# EasyEDA Pro project BCI_TESTING_BOARD.eprj, board BCI_Board
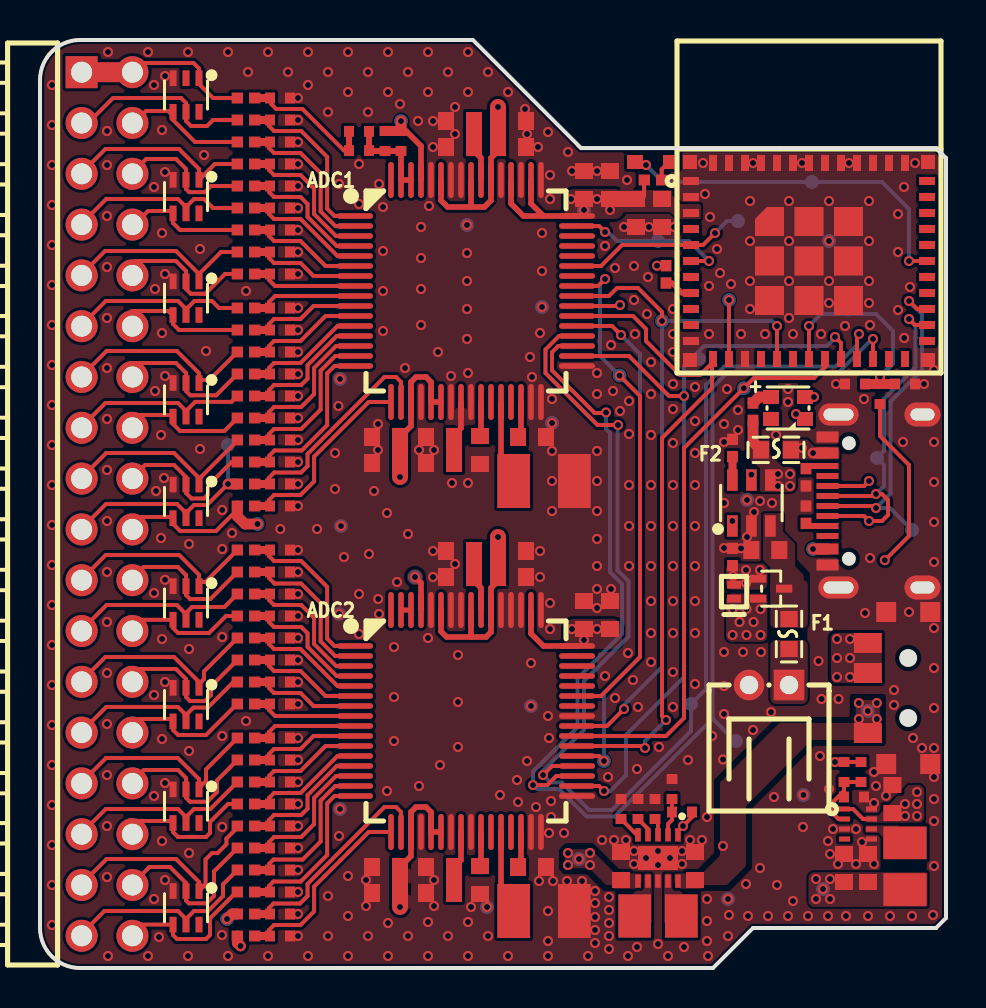
[diagram p4: board, top side]
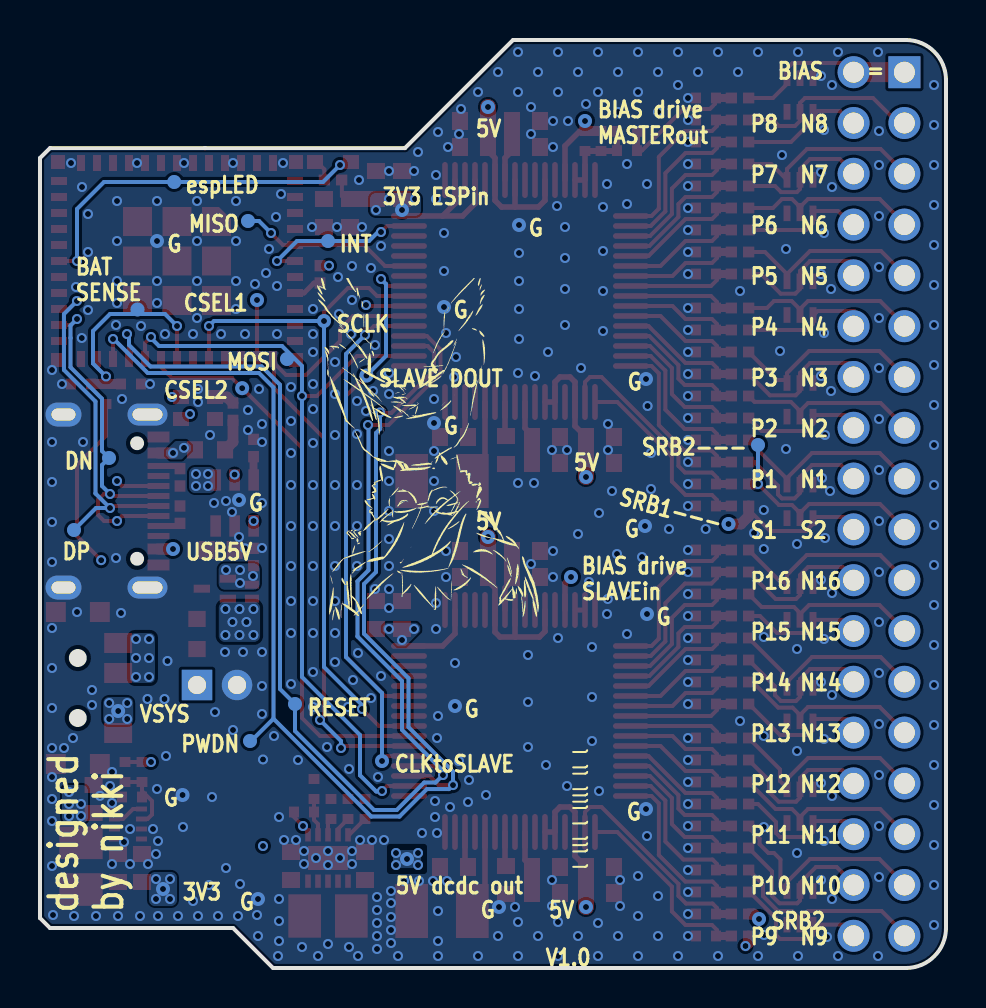
[diagram p5: board, bottom side, seen from below]

Outline 45.3 x 46.4 mm; copper layers: Top Layer, Inner1, Inner2, Bottom Layer. Coordinates in mm from the lower left corner of the outline.
Outline path: 0,44.4 0,2 arc(0.59,0.59) 2,0 33.65,0 35.65,2 44.8,2 45.3,2.5 45.3,2.5 45.3,40.49 45.3,40.49 44.8,40.99 27.05,40.99 21.64,46.4 2,46.4 arc(0.59,45.81) 0,44.4
Stack: Top Layer 0.035mm 外层铜厚1oz / Dielectric1 0.28mm 7628 RC49% 8.6mil / Inner1 0.035mm 内层铜厚 / Dielectric2 0.28mm 1.1mm H/HOZ 含铜 / Inner2 0.035mm 内层铜厚 / Dielectric3 0.28mm 7628 RC49% 8.6mil / Bottom Layer 0.035mm 外层铜厚1oz

## Design rules (mm)
template: 用户自定义配置
spacing Default (default): track to track 0.127, other pairs 0 to 0.127
track width Default (default): min 0.127, default 0.127, max 25.4
differential pair differentialPair (default): width min 0.127, default 0.254, max 2.54; gap min 0.152, default 0.152
via Default (default): diameter min 0.5, default 0.61, max 100.025; hole min 0.3, default 0.305, max 59.995
net GND uses gge20879(1)
net 5V uses gge20879(1)
pour e144 uses gge20879(1)
pour e4232 uses gge20879(1)
pour e3363 uses gge20879(1)
pour e3540 uses gge20879(1)
pour e1719 uses gge20879(1)
pour e1148 uses gge20879(1)
pour e7396 uses gge20879(1)
pour e17882 uses gge20879(1)
pour e4641 uses gge20879(1)
pour e8198 uses gge20879(1)
pour e9053 uses gge20879(1)
pour e2428 uses gge20879(1)
pour e1776 uses gge20879(1)
pour e16471 uses gge20879(1)
pour e20188 uses gge20879(1)
pour e28357 uses gge20879(1)
pour e986 uses gge20879(1)
pour e3342 uses gge20879(1)
pour e4173 uses gge20879(1)
pour e4651 uses gge20879(1)
pour e4938 uses gge20879(1)
pour e2614 uses gge20879(1)
pour e1422 uses gge20879(1)
pour e4659 uses gge20879(1)
pour e5927 uses gge20879(1)
pour e11420 uses gge20879(1)
pour e10603 uses gge20879(1)
pour e60502 uses gge20879(1)
pour e60981 uses gge20879(1)
pour e61780 uses gge20879(1)
pour e62245 uses gge20879(1)
pour e66682 uses gge20879(1)
pour e68252 uses gge20879(1)
pour e68438 uses gge20879(1)
pour e69166 uses gge20879(1)
pour e59833 uses gge20879(1)
pour e60166 uses gge20879(1)
pour e60163 uses gge20879(1)
pour e86477 uses gge20879(1)
pour e92652 uses gge20879(1)
pour e94208 uses gge20879(1)
pour e95223 uses gge20879(1)
pour e1714 uses gge20879(1)
pour e3613 uses gge20879(1)
pour e7332 uses gge20879(1)
pour e12201 uses gge20879(1)
pour e12398 uses gge20879(1)
pour e18760 uses gge20879(1)
pour e20440 uses gge20879(1)
pour e20447 uses gge20879(1)
pour e31094 uses gge20879(1)
pour e32431 uses gge20879(1)
pour e68747 uses gge20879(1)
pour e75484 uses gge20879(1)

## Placement (name value [footprint] x y rotation side)
ADC1  ADS1299IPAGR  [TQFP-64_L10.0-W10.0-P0.50-LS12.0-TL]  21.3 33.85 0 top
ADC2  ADS1299IPAGR  [TQFP-64_L10.0-W10.0-P0.50-LS12.0-TL]  21.3 12.35 0 top
C17  100nF  [C0603]  20 26.55 0 top
C18  10uF  [C0603]  20 25.25 0 top
C19  1uF  [C0603]  22 25.9 270 top
C20  1uF  [C0603]  24.6 26.55 180 top
C21  100uF  [C1210]  25.2 24.35 0 top
C22  1uF  [C0603]  21 42.35 180 top
C23  100nF  [C0603]  21 41.05 180 top
C24  1uF  [C0603]  17.3 25.25 0 top
C25  100nF  [C0603]  17.3 26.55 0 top
C26  10uF  [C0603]  23.6 42.35 180 top
C27  100nF  [C0603]  23.6 41.05 180 top
C28  100nF  [C0603]  27.2 39.15 270 top
C29  1uF  [C0603]  28.5 39.15 270 top
C30  1uF  [C0603]  24.6 5.05 180 top
C31  1uF  [C0603]  22 4.4 270 top
C32  100nF  [C0603]  20 5.05 0 top
C33  100uF  [C1210]  25.2 2.85 0 top
C34  1uF  [C0603]  21 20.85 180 top
C35  100nF  [C0603]  21 19.55 180 top
C36  100nF  [C0603]  17.3 5.05 0 top
C37  100nF  [C0603]  23.6 19.55 180 top
C38  10uF  [C0603]  20 3.75 0 top
C39  10uF  [C0603]  23.6 20.85 180 top
C40  1uF  [C0603]  17.3 3.75 0 top
C41  100nF  [C0603]  27.2 17.65 270 top
C42  1uF  [C0603]  28.5 17.65 270 top
C101  4.7nF  [C0402 small]  12 25.3 0 top
C102  4.7nF  [C0402 small]  12 26.4 180 top
C103  4.7nF  [C0402 small]  12 27.5 0 top
C104  4.7nF  [C0402 small]  12 28.6 180 top
C105  4.7nF  [C0402 small]  12 29.7 0 top
C106  4.7nF  [C0402 small]  12 30.8 180 top
C107  4.7nF  [C0402 small]  12 31.9 0 top
C108  4.7nF  [C0402 small]  12 33 180 top
C109  4.7nF  [C0402 small]  12 34.7 0 top
C110  4.7nF  [C0402 small]  12 35.8 180 top
C111  4.7nF  [C0402 small]  12 36.9 0 top
C112  4.7nF  [C0402 small]  12 38 180 top
C113  4.7nF  [C0402 small]  12 39.1 0 top
C114  4.7nF  [C0402 small]  12 40.2 180 top
C115  4.7nF  [C0402 small]  12 41.3 0 top
C116  4.7nF  [C0402 small]  12 42.4 180 top
C201  4.7nF  [C0402 small]  12 3.8 0 top
C202  4.7nF  [C0402 small]  12 4.9 180 top
C203  4.7nF  [C0402 small]  12 6 0 top
C204  4.7nF  [C0402 small]  12 7.1 180 top
C205  4.7nF  [C0402 small]  12 8.2 0 top
C206  4.7nF  [C0402 small]  12 9.3 180 top
C207  4.7nF  [C0402 small]  12 10.4 0 top
C208  4.7nF  [C0402 small]  12 11.5 180 top
C209  4.7nF  [C0402 small]  12 13.2 0 top
C210  4.7nF  [C0402 small]  12 14.3 180 top
C211  4.7nF  [C0402 small]  12 15.4 0 top
C212  4.7nF  [C0402 small]  12 16.5 180 top
C213  4.7nF  [C0402 small]  12 17.6 0 top
C214  4.7nF  [C0402 small]  12 18.7 180 top
C215  4.7nF  [C0402 small]  12 19.8 0 top
C216  4.7nF  [C0402 small]  12 20.9 180 top
C222  10uF  [C0603]  29.8 37.75 270 top
C223  100nF  [C0603]  31.1 37.75 270 top
C227  4.7uF  [C0603]  42.62 8.45 270 top
C228  10uF  [C0603]  41.4 5 270 top
C231  10uF  [C0603]  40.2 5 90 top
C232  10uF  [C0603]  32.75 5.1 90 top
C233  22uF  [C0603]  29.05 5.1 270 top
C234  120pF  [C0402 small]  41.05 9.8 90 top
C_adc  100nF  [C0402 small]  40.75 29.2 180 top
CBIAS1  4.7nF  [C0402 small]  12 43.5 180 top
Cbias3  1.5nF  [C0402 small]  15.95 41.83 0 top
Cbias4  1.5nF  [C0402 small]  17.25 41.35 90 top
CP1  10uF  [C0603]  36.27 20.9 0 top
Csrb11  4.7nF  [C0402 small]  12 23.1 180 top
Csrb12  4.7nF  [C0402 small]  12 24.2 0 top
Csrb21  4.7nF  [C0402 small]  12 1.6 180 top
Csrb22  4.7nF  [C0402 small]  12 2.7 0 top
D1  TPD4E1B06DCKR  [SC-70-6_L2.2-W1.3-P0.65-LS2.1-BL]  7.3 23.33 180 top
D2  TPD4E1B06DCKR  [SC-70-6_L2.2-W1.3-P0.65-LS2.1-BL]  7.3 28.41 180 top
D3  TPD4E1B06DCKR  [SC-70-6_L2.2-W1.3-P0.65-LS2.1-BL]  7.3 33.49 180 top
D4  TPD4E1B06DCKR  [SC-70-6_L2.2-W1.3-P0.65-LS2.1-BL]  7.3 38.57 180 top
D5  TPD4E1B06DCKR  [SC-70-6_L2.2-W1.3-P0.65-LS2.1-BL]  7.3 43.65 180 top
D7  TPD4E1B06DCKR  [SC-70-6_L2.2-W1.3-P0.65-LS2.1-BL]  7.3 3.01 180 top
D8  TPD4E1B06DCKR  [SC-70-6_L2.2-W1.3-P0.65-LS2.1-BL]  7.3 8.09 180 top
D9  TPD4E1B06DCKR  [SC-70-6_L2.2-W1.3-P0.65-LS2.1-BL]  7.3 13.17 180 top
D10  TPD4E1B06DCKR  [SC-70-6_L2.2-W1.3-P0.65-LS2.1-BL]  7.3 18.25 180 top
D11  RB161QS-40T18R  [X2-DFN1006-2_L1.0-W0.6-P0.65-RD]  34.7 18.82 90 top
F1  0467001.NRHF  [F0603]  37.45 16.7 270 top
F2  0467001.NRHF  [F0603]  36.8 25.91 180 top
H3  X6521WR-2x18H-C60D30  [HDR-TH_36P-P2.54-H-M-R2-C18-S2.54]  3.35 23.2 270 top
L1  470nH  [L1008]  43.25 5.09 270 top
L2  2.2uH  [L1008]  30.9 2.6 180 top
LED1  NH-B2020RGBA-HF  [LED-ARRAY-SMD_4P-L2.1-W2.1-TL_NH-B2020RGBA]  37.4 28 180 top
LED2  XL-1606UWC  [LED-SMD_L1.7-W0.6-RD]  30.65 40.3 0 top
NOREF  -  [Pad_e34786]  9.4 26.15 0 top
NOREF#2  -  [Pad_e23853]  34.45 33.4 0 top
NOREF#3  -  [Pad_e26715]  38.65 20.95 0 top
NOREF#4  -  [Pad_e45393]  34.4 3.45 0 top
NOREF#5  -  [Pad_e34781]  18.75 19.55 0 top
NOREF#6  -  [Pad_e10843]  9.35 2.45 0 top
NOREF#7  -  [Pad_e34780]  18 3.05 0 top
NOREF#8  -  [Pad_e15223]  15 7.95 0 top
NOREF#9  -  [Pad_e43292]  35.35 23.4 0 top
NOREF#10  -  [Pad_e33291]  34.9 37.35 270 top
NOREF#11  -  [Pad_e34785]  22.9 21.55 0 top
NOREF#12  -  [Pad_e34784]  22.9 43.05 0 top
NOREF#13  -  [Pad_e22556]  22.35 3.05 0 top
NOREF#14  -  [Pad_e26879]  30.9 36.35 0 top
NOREF#15  -  [Pad_e26221]  26.95 5.45 0 top
NOREF#16  -  [Pad_e849]  14.95 17.7 0 top
NOREF#17  -  [Pad_e563]  15.05 22.1 0 top
NOREF#18  -  [Pad_e38374]  34.8 11.35 0 top
NOREF#19  -  [Pad_e22746]  38.17 8.65 0 top
NOREF#20  -  [Pad_e34782]  18 24.55 0 top
NOREF#21  -  [Pad_e43633]  25.6 27.25 0 top
NOREF#22  -  [Pad_e11620]  25.1 33.05 0 top
NOREF#23  -  [Pad_e26220]  39.15 3.95 0 top
NOREF#24  -  [Pad_e26066]  35.19 28.99 0 top
NOREF#25  -  [Pad_e10842]  21.35 37.15 0 top
NOREF#26  -  [Pad_e20400]  41.85 25.5 0 top
NOREF#27  -  [Pad_e23500]  15 29.45 0 top
NOREF#28  -  [Pad_e34783]  18.05 42.35 0 top
NOREF#29  -  [Pad_e24511]  31.1 32.35 0 top
NOREF#30  -  [Pad_e26392]  41.39 12.85 0 top
NOREF#31  -  [Pad_e39047]  32.55 13.2 0 top
NOREF#32  -  [Pad_e30508]  28.98 29.62 0 top
NOREF#33  -  [Pad_e28035]  40.42 32.92 0 top
NOREF#34  -  [Pad_e28860]  38.59 39.3 0 top
NOREF#35  -  [Pad_e41240]  28.2 10.35 0 top
NOREF#36  -  [Pad_e34787]  10.87 22.2 0 top
NOREF#37  -  [Pad_e43800]  24.55 13.1 0 top
NOREF#38  -  [Pad_e43099]  39.45 36.35 0 top
NOREF#39  -  [Pad_e11427]  27.2 37.9 0 top
NOREF#40  -  [Pad_e27868]  32.95 30.45 0 top
NOREF#41  -  [Pad_e20399]  43.6 21.9 0 top
P1  TP4057-42-SOT26-R  [SOT-23-6_L2.9-W1.6-P0.95-LS2.8-BL]  35.57 23.25 0 top
Q1  DMG1013T-7  [SC-75-3_L1.6-W0.8-P1.00-LS1.6-BR]  36.56 18.97 180 top
R1  4.7kΩ  [R0402]  31.3 34.68 270 top
R8  10kΩ  [R0402]  34.62 20.55 270 top
R101  4.7kΩ  [R0402]  10.3 25.3 0 top
R102  4.7kΩ  [R0402]  10.3 26.4 0 top
R103  4.7kΩ  [R0402]  10.3 27.5 0 top
R104  4.7kΩ  [R0402]  10.3 28.6 0 top
R105  4.7kΩ  [R0402]  10.3 29.7 0 top
R106  4.7kΩ  [R0402]  10.3 30.8 0 top
R107  4.7kΩ  [R0402]  10.3 31.9 0 top
R108  4.7kΩ  [R0402]  10.3 33 0 top
R109  4.7kΩ  [R0402]  10.3 34.7 0 top
R110  4.7kΩ  [R0402]  10.3 35.8 0 top
R111  4.7kΩ  [R0402]  10.3 36.9 0 top
R112  4.7kΩ  [R0402]  10.3 38 0 top
R113  4.7kΩ  [R0402]  10.3 39.1 0 top
R114  4.7kΩ  [R0402]  10.3 40.2 0 top
R115  4.7kΩ  [R0402]  10.3 41.3 0 top
R116  4.7kΩ  [R0402]  10.3 42.4 0 top
R201  4.7kΩ  [R0402]  10.3 3.8 0 top
R202  4.7kΩ  [R0402]  10.3 4.9 0 top
R203  4.7kΩ  [R0402]  10.3 6 0 top
R204  4.7kΩ  [R0402]  10.3 7.1 0 top
R205  4.7kΩ  [R0402]  10.3 8.2 0 top
R206  4.7kΩ  [R0402]  10.3 9.3 0 top
R207  4.7kΩ  [R0402]  10.3 10.4 0 top
R208  4.7kΩ  [R0402]  10.3 11.5 0 top
R209  4.7kΩ  [R0402]  10.3 13.2 0 top
R210  4.7kΩ  [R0402]  10.3 14.3 0 top
R211  4.7kΩ  [R0402]  10.3 15.4 0 top
R212  4.7kΩ  [R0402]  10.3 16.5 0 top
R213  4.7kΩ  [R0402]  10.3 17.6 0 top
R214  4.7kΩ  [R0402]  10.3 18.7 0 top
R215  4.7kΩ  [R0402]  10.3 19.8 0 top
R216  4.7kΩ  [R0402]  10.3 20.9 0 top
R_adc1  10kΩ  [C0402 small]  43.25 29.2 0 top
R_adc2  47kΩ  [C0402 small]  42 28.7 270 top
RA1  2kΩ  [R0402]  34.62 26 90 top
Rb1  470kΩ  [C0402 small]  40.2 9.8 270 top
Rb2  107kΩ  [C0402 small]  40.7 8.55 180 top
Rb3  36.5kΩ  [C0402 small]  29.05 7.95 270 top
Rb4  8.25kΩ  [C0402 small]  29.9 7.95 90 top
Rb5  36.5kΩ  [C0402 small]  30.75 7.95 90 top
Rb6  0Ω  [C0402 small]  31.6 8.95 270 top
Rb7  0Ω  [C0402 small]  32.1 7.8 0 top
RBIAS1  1MΩ  [C0402 small]  18.05 41.35 90 top
RBIAS4  1MΩ  [C0402 small]  15.95 40.87 180 top
RBIAS5  4.7kΩ  [R0402]  10.3 43.5 0 top
RD1  5.1kΩ  [R0402]  38.3 22.67 270 top
RD2  5.1kΩ  [R0402]  38.3 24.53 90 top
RL1  2kΩ  [R0402]  35.65 27.82 270 top
RL2  2kΩ  [R0402]  30.65 39.4 0 top
Rsrb11  4.7kΩ  [R0402]  10.3 23.1 0 top
Rsrb12  4.7kΩ  [R0402]  10.3 24.2 0 top
Rsrb21  4.7kΩ  [R0402]  10.3 1.6 0 top
Rsrb22  4.7kΩ  [R0402]  10.3 2.7 0 top
SW4  SK-3296S-01-L1  [SW-SMD_3P-P1.50_L2.7-W6.6]  42.95 14 90 top
U2  ESP32-C3-MINI-1-H4X  [WIFIM-SMD_ESP32-C3-MINI-1]  38.45 35.35 0 top
U14  TPS62821DLCR  [VSON-8_L2.0-W1.5-P0.50-BL]  40.9 7.2 270 top
U15  TPS63900DSKR  [WSON-10_L2.5-W2.5-W0.50-TL-EP]  30.9 5.5 270 top
U16  WAFER-PH2.0-2PWZ  [CONN-TH_2P-P2.00_GP01-2001WR-2P]  36.45 14.15 180 top
USB1  TYPE-C 16PIN 2MD(073)  [USB-C-SMD_TYPE-C-6PIN-2MD-073]  41.75 23.35 90 top

## Footprints (pads in the part's own frame, mm; a bottom-side part is the same pattern mirrored in y, then rotated)
C0402 small
  rect 0.5x0.54 smd: 1(-0.5,0) 2(0.5,0)
C0603
  rect 0.8x0.9 smd: 1(-0.7,0) 2(0.7,0)
C1210
  rect 1.635x2.7 smd: 1(-1.518,0) 2(1.518,0)
CONN-TH_2P-P2.00_GP01-2001WR-2P
  rect 1.524x1.524 hole 0.914: 1(-1,0)
  round 1.524 hole 0.914: 2(1,0)
F0603
  rect 0.806x0.864 smd: 1(-0.753,0) 2(0.753,0)
HDR-TH_36P-P2.54-H-M-R2-C18-S2.54
  rect 1.6x1.6 hole 1.05: 1(-21.59,-1.27)
  round 1.6 hole 1.05: 2(-21.59,1.27) 3(-19.05,-1.27) 4(-19.05,1.27) 5(-16.51,-1.27) 6(-16.51,1.27) 7(-13.97,-1.27) 8(-13.97,1.27) 9(-11.43,-1.27) 10(-11.43,1.27) 11(-8.89,-1.27) 12(-8.89,1.27) 13(-6.35,-1.27) 14(-6.35,1.27) 15(-3.81,-1.27) 16(-3.81,1.27) 17(-1.27,-1.27) 18(-1.27,1.27) 19(1.27,-1.27) 20(1.27,1.27) 21(3.81,-1.27) 22(3.81,1.27) 23(6.35,-1.27) 24(6.35,1.27) 25(8.89,-1.27) 26(8.89,1.27) 27(11.43,-1.27) 28(11.43,1.27) 29(13.97,-1.27) 30(13.97,1.27) 31(16.51,-1.27) 32(16.51,1.27) 33(19.05,-1.27) 34(19.05,1.27) 35(21.59,-1.27) 36(21.59,1.27)
L1008
  rect 1.635x2.16 smd: 1(-1.167,0) 2(1.167,0)
LED-ARRAY-SMD_4P-L2.1-W2.1-TL_NH-B2020RGBA
  rect 0.8x0.7 smd: 1(-0.85,0.55) 2(0.85,0.55) 3(0.85,-0.55) 4(-0.85,-0.55)
LED-SMD_L1.7-W0.6-RD
  rect 0.8x0.7 smd: 1(-0.9,0) 2(0.9,0)
Pad_e563
  round 0.7 smd far side: TP2(0,0)
Pad_e849
  round 0.7 smd far side: TP2(0,0)
Pad_e10842
  round 0.7 smd far side: TP2(0,0)
Pad_e10843
  round 0.7 smd far side: TP2(0,0)
Pad_e11427
  round 0.7 smd far side: TP2(0,0)
Pad_e11620
  round 0.7 smd far side: TP2(0,0)
Pad_e15223
  round 0.7 smd far side: TP2(0,0)
Pad_e20399
  round 0.7 smd far side: TP2(0,0)
Pad_e20400
  round 0.7 smd far side: TP2(0,0)
Pad_e22556
  round 0.7 smd far side: TP2(0,0)
Pad_e22746
  round 0.7 smd far side: TP2(0,0)
Pad_e23500
  round 0.7 smd far side: TP2(0,0)
Pad_e23853
  round 0.7 smd far side: TP2(0,0)
Pad_e24511
  round 0.7 smd far side: TP2(0,0)
Pad_e26066
  round 0.7 smd far side: TP2(0,0)
Pad_e26220
  round 0.7 smd far side: TP2(0,0)
Pad_e26221
  round 0.7 smd far side: TP2(0,0)
Pad_e26392
  round 0.7 smd far side: TP2(0,0)
Pad_e26715
  round 0.7 smd far side: TP2(0,0)
Pad_e26879
  round 0.7 smd far side: TP2(0,0)
Pad_e27868
  round 0.7 smd far side: TP2(0,0)
Pad_e28035
  round 0.7 smd far side: TP2(0,0)
Pad_e28860
  round 0.7 smd far side: TP2(0,0)
Pad_e30508
  round 0.7 smd far side: TP2(0,0)
Pad_e33291
  round 0.7 smd far side: TP2(0,0)
Pad_e34780
  round 0.7 smd far side: TP2(0,0)
Pad_e34781
  round 0.7 smd far side: TP2(0,0)
Pad_e34782
  round 0.7 smd far side: TP2(0,0)
Pad_e34783
  round 0.7 smd far side: TP2(0,0)
Pad_e34784
  round 0.7 smd far side: TP2(0,0)
Pad_e34785
  round 0.7 smd far side: TP2(0,0)
Pad_e34786
  round 0.7 smd far side: TP2(0,0)
Pad_e34787
  round 0.7 smd far side: TP2(0,0)
Pad_e38374
  round 0.7 smd far side: TP2(0,0)
Pad_e39047
  round 0.7 smd far side: TP2(0,0)
Pad_e41240
  round 0.7 smd far side: TP2(0,0)
Pad_e43099
  round 0.7 smd far side: TP2(0,0)
Pad_e43292
  round 0.7 smd far side: TP2(0,0)
Pad_e43633
  round 0.7 smd far side: TP2(0,0)
Pad_e43800
  round 0.7 smd far side: TP2(0,0)
Pad_e45393
  round 0.7 smd far side: TP2(0,0)
R0402
  rect 0.566x0.54 smd: 1(-0.433,0) 2(0.433,0)
SC-70-6_L2.2-W1.3-P0.65-LS2.1-BL
  rect 0.35x0.78 smd: 1(-0.65,-0.84) 2(0,-0.84) 3(0.65,-0.84) 4(0.65,0.84) 5(0,0.84) 6(-0.65,0.84)
SC-75-3_L1.6-W0.8-P1.00-LS1.6-BR
  rect 0.816x0.4 smd: 1(0.65,-0.5) 2(0.65,0.5) 3(-0.65,0)
SOT-23-6_L2.9-W1.6-P0.95-LS2.8-BL
  rect 0.532x1.072 smd: 1(-0.95,-1.149) 2(0,-1.149) 3(0.95,-1.149) 4(0.95,1.149) 5(0,1.149) 6(-0.95,1.149)
SW-SMD_3P-P1.50_L2.7-W6.6
  rect 1x1 smd: 0(-3.8,0.641) 0(-3.8,-1.559) 0(3.8,0.641) 0(3.8,-1.559)
  rect 1x1.4 smd: 1(-2.25,1.559) 2(0.75,1.559) 3(2.25,1.559)
TQFP-64_L10.0-W10.0-P0.50-LS12.0-TL
  oval 1.8x0.28 smd: 1(-5.55,3.75) 2(-5.55,3.25) 3(-5.55,2.75) 4(-5.55,2.25) 5(-5.55,1.75) 6(-5.55,1.25) 7(-5.55,0.75) 8(-5.55,0.25) 9(-5.55,-0.25) 10(-5.55,-0.75) 11(-5.55,-1.25) 12(-5.55,-1.75) 13(-5.55,-2.25) 14(-5.55,-2.75) 15(-5.55,-3.25) 16(-5.55,-3.75) 33(5.55,-3.75) 34(5.55,-3.25) 35(5.55,-2.75) 36(5.55,-2.25) 37(5.55,-1.75) 38(5.55,-1.25) 39(5.55,-0.75) 40(5.55,-0.25) 41(5.55,0.25) 42(5.55,0.75) 43(5.55,1.25) 44(5.55,1.75) 45(5.55,2.25) 46(5.55,2.75) 47(5.55,3.25) 48(5.55,3.75)
  oval 0.28x1.8 smd: 17(-3.75,-5.55) 18(-3.25,-5.55) 19(-2.75,-5.55) 20(-2.25,-5.55) 21(-1.75,-5.55) 22(-1.25,-5.55) 23(-0.75,-5.55) 24(-0.25,-5.55) 25(0.25,-5.55) 26(0.75,-5.55) 27(1.25,-5.55) 28(1.75,-5.55) 29(2.25,-5.55) 30(2.75,-5.55) 31(3.25,-5.55) 32(3.75,-5.55) 49(3.75,5.55) 50(3.25,5.55) 51(2.75,5.55) 52(2.25,5.55) 53(1.75,5.55) 54(1.25,5.55) 55(0.75,5.55) 56(0.25,5.55) 57(-0.25,5.55) 58(-0.75,5.55) 59(-1.25,5.55) 60(-1.75,5.55) 61(-2.25,5.55) 62(-2.75,5.55) 63(-3.25,5.55) 64(-3.75,5.55)
USB-C-SMD_TYPE-C-6PIN-2MD-073
  rect 0.55x1.1 smd: 1(-3.2,2.375) 2(-2.4,2.375) 11(2.4,2.375) 12(3.2,2.375)
  rect 0.3x1.1 smd: 3(-1.75,2.375) 4(-1.25,2.375) 5(-0.75,2.375) 6(-0.25,2.375) 7(0.25,2.375) 8(0.75,2.375) 9(1.25,2.375) 10(1.75,2.375)
  oval 1.1x2 hole 0.6x1.5: 13(-4.325,1.825) 14(4.325,1.825)
  oval 1.2x1.8 hole 0.6x1.2: 13(-4.325,-2.375) 14(4.325,-2.375)
VSON-8_L2.0-W1.5-P0.50-BL
  rect 0.25x0.55 smd: 1(-0.75,-0.675) 2(-0.25,-0.675) 3(0.25,-0.675) 4(0.75,-0.675) 5(0.75,0.675) 6(0.25,0.675) 7(-0.25,0.675) 8(-0.75,0.675)
WIFIM-SMD_ESP32-C3-MINI-1
  rect 0.8x0.4 smd: 1(-5.9,4) 2(-5.9,3.2) 3(-5.9,2.4) 4(-5.9,1.6) 5(-5.9,0.8) 6(-5.9,0) 7(-5.9,-0.8) 8(-5.9,-1.6) 9(-5.9,-2.4) 10(-5.9,-3.2) 11(-5.9,-4) 25(5.9,-4) 26(5.9,-3.2) 27(5.9,-2.4) 28(5.9,-1.6) 29(5.9,-0.8) 30(5.9,0) 31(5.9,0.8) 32(5.9,1.6) 33(5.9,2.4) 34(5.9,3.2) 35(5.9,4)
  rect 0.4x0.8 smd: 12(-4.8,-4.9) 13(-4,-4.9) 14(-3.2,-4.9) 15(-2.4,-4.9) 16(-1.6,-4.9) 17(-0.8,-4.9) 18(0,-4.9) 19(0.8,-4.9) 20(1.6,-4.9) 21(2.4,-4.9) 22(3.2,-4.9) 23(4,-4.9) 24(4.8,-4.9) 36(4.8,4.9) 37(4,4.9) 38(3.2,4.9) 39(2.4,4.9) 40(1.6,4.9) 41(0.8,4.9) 42(0,4.9) 43(-0.8,4.9) 44(-1.6,4.9) 45(-2.4,4.9) 46(-3.2,4.9) 47(-4,4.9) 48(-4.8,4.9)
  custom 1.45x1.45 smd: 49(-1.975,1.975)
  rect 1.45x1.45 smd: 49(-1.975,0) 49(-1.975,-1.975) 49(0,1.975) 49(0,0) 49(0,-1.975) 49(1.975,1.975) 49(1.975,0) 49(1.975,-1.975)
  rect 0.7x0.7 smd: 50(5.95,4.95) 51(5.95,-4.95) 52(-5.95,-4.95) 53(-5.95,4.95)
WSON-10_L2.5-W2.5-W0.50-TL-EP
  rect 0.665x0.28 smd: 1(-1.157,1) 2(-1.157,0.5) 3(-1.157,0) 4(-1.157,-0.5) 5(-1.157,-1) 6(1.157,-1) 7(1.157,-0.5) 8(1.157,0) 9(1.157,0.5) 10(1.157,1)
  rect 1.2x2 smd: 11(0,0)
X2-DFN1006-2_L1.0-W0.6-P0.65-RD
  rect 0.4x0.7 smd: 1(-0.35,0) 2(0.35,0)

## Nets
3V3: ADC1.48 ADC1.50 ADC1.52 ADC2.48 ADC2.50 C28.2 C29.2 C41.2 C42.2 C222.1 C223.1 C228.2 C231.1 C234.2 L1.2 NOREF#23.TP2 NOREF#39.TP2 R1.1 Rb1.1 RL2.1 U2.3
5V: ADC1.19 ADC1.21 ADC1.22 ADC1.54 ADC1.56 ADC1.59 ADC2.19 ADC2.21 ADC2.22 ADC2.54 ADC2.56 ADC2.59 C24.2 C25.2 C26.2 C27.2 C36.2 C37.2 C39.2 C40.2 C233.2 NOREF#7.TP2 NOREF#11.TP2 NOREF#12.TP2 NOREF#15.TP2 NOREF#20.TP2 U15.6
GND: ADC1.20 ADC1.23 ADC1.25 ADC1.31 ADC1.32 ADC1.33 ADC1.49 ADC1.51 ADC1.53 ADC1.57 ADC1.58 ADC1.60 ADC2.20 ADC2.23 ADC2.25 ADC2.31 ADC2.32 ADC2.33 ADC2.41 ADC2.49 ADC2.51 ADC2.52 ADC2.53 ADC2.57 ADC2.58 ADC2.60 C17.1 C18.1 C19.2 C20.1 C21.2 C22.2 C23.2 C24.1 C25.1 C26.1 C27.1 C28.1 C29.1 C30.1 C31.2 C32.1 C33.2 C34.2 C35.2 C36.1 C37.1 C38.1 C39.1 C40.1 C41.1 C42.1 C101.2 C102.1 C103.2 C104.1 C105.2 C106.1 C107.2 C108.1 C109.2 C110.1 C111.2 C112.1 C113.2 C114.1 C115.2 C116.1 C201.2 C202.1 C203.2 C204.1 C205.2 C206.1 C207.2 C208.1 C209.2 C210.1 C211.2 C212.1 C213.2 C214.1 C215.2 C216.1 C222.2 C223.2 C227.1 C228.1 C231.2 C232.2 C233.1 C_adc.2 CBIAS1.1 CP1.1 Csrb11.1 Csrb12.2 Csrb21.1 Csrb22.2 D1.3 D2.3 D3.3 D4.3 D5.3 D7.3 D8.3 D9.3 D10.3 NOREF#4.TP2 NOREF#8.TP2 NOREF#9.TP2 NOREF#13.TP2 NOREF#16.TP2 NOREF#17.TP2 NOREF#19.TP2 NOREF#21.TP2 NOREF#22.TP2 NOREF#25.TP2 NOREF#27.TP2 NOREF#37.TP2 NOREF#38.TP2 P1.2 R8.1 R_adc1.2 RA1.2 Rb2.1 Rb3.1 Rb4.2 Rb5.2 Rb6.1 RD1.1 RD2.1 SW4.0 U2.1 U2.2 U2.11 U2.14 U2.36 U2.37 U2.38 U2.39 U2.40 U2.41 U2.42 U2.43 U2.44 U2.45 U2.46 U2.47 U2.48 U2.49 U2.50 U2.51 U2.52 U2.53 U14.3 U14.5 U14.8 U15.8 U15.11 U16.2 USB1.1 USB1.12 USB1.13 USB1.14
VIN: C227.2 C232.1 NOREF#30.TP2 R_adc2.2 Rb7.2 SW4.1 U14.1 U14.7 U15.1 U15.10
ADC: C_adc.1 NOREF#33.TP2 R_adc1.1 R_adc2.1 U2.18
B: LED2.1 NOREF#34.TP2 U2.30
BAT+: CP1.2 F1.1 P1.3 Q1.3
BIAS_DRV: CBIAS1.2 Cbias3.1 RBIAS4.2 RBIAS5.2
BIASINV: ADC1.61 ADC2.61 Cbias4.2 NOREF#5.TP2 NOREF#28.TP2 RBIAS1.2
CLK: ADC1.37 ADC2.37 NOREF#35.TP2
CSEL1: ADC1.39 NOREF#2.TP2 U2.13
CSEL2: ADC2.39 NOREF#24.TP2 U2.19
DN: NOREF#26.TP2 U2.26 USB1.5 USB1.7
DP: NOREF#41.TP2 U2.27 USB1.6 USB1.8
G: LED1.4 P1.5
IN1N: ADC1.15 C102.2 R102.2
IN1N1: ADC2.15 C202.2 R202.2
IN1P: ADC1.16 C101.1 R101.2
IN1P1: ADC2.16 C201.1 R201.2
IN2N: ADC1.13 C104.2 R104.2
IN2N1: ADC2.13 C204.2 R204.2
IN2P: ADC1.14 C103.1 R103.2
IN2P1: ADC2.14 C203.1 R203.2
IN3N: ADC1.11 C106.2 R106.2
IN3N1: ADC2.11 C206.2 R206.2
IN3P: ADC1.12 C105.1 R105.2
IN3P1: ADC2.12 C205.1 R205.2
IN4N: ADC1.9 C108.2 R108.2
IN4N1: ADC2.9 C208.2 R208.2
IN4P: ADC1.10 C107.1 R107.2
IN4P1: ADC2.10 C207.1 R207.2
IN5N: ADC1.7 C110.2 R110.2
IN5N1: ADC2.7 C210.2 R210.2
IN5P: ADC1.8 C109.1 R109.2
IN5P1: ADC2.8 C209.1 R209.2
IN6N: ADC1.5 C112.2 R112.2
IN6N1: ADC2.5 C212.2 R212.2
IN6P: ADC1.6 C111.1 R111.2
IN6P1: ADC2.6 C211.1 R211.2
IN7N: ADC1.3 C114.2 R114.2
IN7N1: ADC2.3 C214.2 R214.2
IN7P: ADC1.4 C113.1 R113.2
IN7P1: ADC2.4 C213.1 R213.2
IN8N: ADC1.1 C116.2 R116.2
IN8N1: ADC2.1 C216.2 R216.2
IN8P: ADC1.2 C115.1 R115.2
IN8P1: ADC2.2 C215.1 R215.2
INT: ADC1.47 NOREF#14.TP2 U2.6
MISO: ADC1.43 NOREF#10.TP2 U2.5
MOSI: ADC1.34 ADC2.34 NOREF#40.TP2 U2.20
PBIAS: D5.1 H3.1 H3.2 RBIAS5.1
PIN1N: D1.1 H3.17 R102.1
PIN1N1: D7.5 H3.35 R202.1
PIN1P: D1.2 H3.18 R101.1
PIN1P1: D7.4 H3.36 R201.1
PIN2N: D2.5 H3.15 R104.1
PIN2N1: D7.1 H3.33 R204.1
PIN2P: D2.4 H3.16 R103.1
PIN2P1: D7.2 H3.34 R203.1
PIN3N: D2.1 H3.13 R106.1
PIN3N1: D8.5 H3.31 R206.1
PIN3P: D2.2 H3.14 R105.1
PIN3P1: D8.4 H3.32 R205.1
PIN4N: D3.5 H3.11 R108.1
PIN4N1: D8.1 H3.29 R208.1
PIN4P: D3.4 H3.12 R107.1
PIN4P1: D8.2 H3.30 R207.1
PIN5N: D3.1 H3.9 R110.1
PIN5N1: D9.5 H3.27 R210.1
PIN5P: D3.2 H3.10 R109.1
PIN5P1: D9.4 H3.28 R209.1
PIN6N: D4.5 H3.7 R112.1
PIN6N1: D9.1 H3.25 R212.1
PIN6P: D4.4 H3.8 R111.1
PIN6P1: D9.2 H3.26 R211.1
PIN7N: D4.1 H3.5 R114.1
PIN7N1: D10.5 H3.23 R214.1
PIN7P: D4.2 H3.6 R113.1
PIN7P1: D10.4 H3.24 R213.1
PIN8N: D5.5 H3.3 R116.1
PIN8N1: D10.1 H3.21 R216.1
PIN8P: D5.4 H3.4 R115.1
PIN8P1: D10.2 H3.22 R215.1
PINSRB1: D1.4 H3.20 NOREF#36.TP2 Rsrb11.1 Rsrb21.1
PINSRB2: D1.5 H3.19 NOREF.TP2 NOREF#6.TP2 Rsrb12.1 Rsrb22.1
PWDN: ADC1.35 ADC2.35 NOREF#18.TP2 U2.22
R: LED1.1 P1.1
RESET: ADC1.36 ADC2.36 NOREF#31.TP2 U2.21
SCLK: ADC1.40 ADC2.40 NOREF#29.TP2 U2.16
SLAVE_DOUT: ADC1.41 ADC2.43 NOREF#32.TP2
SRB1: ADC1.17 Csrb11.2 Rsrb11.2
SRB2: ADC1.18 Csrb12.1 Rsrb12.2
SRB11: ADC2.17 Csrb21.2 Rsrb21.2
SRB21: ADC2.18 Csrb22.1 Rsrb22.2
START: ADC1.38 ADC2.38 U2.12
USB_5V: D11.2 F2.2 P1.4 Q1.1 R8.2 RL1.2
USB_5V_IN: F2.1 NOREF#3.TP2 USB1.2 USB1.11
VREFP: ADC1.24 C17.2 C18.2
VREFP1: ADC2.24 C32.2 C38.2
VSYS: D11.1 Q1.2 SW4.2 SW4.3
$1N289254: R1.2 U2.8
$1N290221: L1.1 U14.6
$1N290224: C234.1 Rb1.2 Rb2.2 U14.2
$1N290773: RD1.2 USB1.4
$1N290774: RD2.2 USB1.10
$1N300888: P1.6 RA1.1
$1N327432: LED2.2 RL2.2
$1N332647: LED1.3 RL1.1
$1N370342: Rb3.2 U15.5
$1N381046: L2.1 U15.9
$1N381052: L2.2 U15.7
$1N381078: Rb4.1 U15.4
$1N381086: Rb5.1 U15.3
$1N397177: Rb6.2 Rb7.1 U15.2
$1N406824: F1.2 U16.1
$2N2542: ADC2.55 C34.1 C35.1
$2N2551: ADC2.30 C30.2
$2N2552: ADC2.26 C31.1
$2N2553: ADC2.28 C33.1
$2N2574: ADC1.30 C20.2
$2N2575: ADC1.26 C19.1
$2N2577: ADC1.28 C21.1
$2N2597: ADC1.62 ADC1.63 Cbias3.2 Cbias4.1 RBIAS1.1 RBIAS4.1
$2N2598: ADC1.55 C22.1 C23.1

Pads without a net: ADC1 27 29 42 44 45 46 64; ADC2 27 29 42 44 45 46 47 62 63 64; D1 6; D2 6; D3 6; D4 6; D5 2 6; D7 6; D8 6; D9 6; D10 6; LED1 2; U2 4 7 9 10 15 17 23 24 25 28 29 31 32 33 34 35; U14 4; USB1 3 9

## Via types
v1: diameter 0.5, hole 0.3, Top Layer to Bottom Layer, 617 vias
